# EAGLE board Resistor_Resistor (EAGLE 8.3.0), part 20 of 32
## Placement (x,y rotation side) (continued)
R24234  10K  [0201]  172.87,21.39 0 top
R24235  10K  [0201]  172.87,22 0 top
R24236  10K  [0201]  172.87,22.61 0 top
R24237  10K  [0201]  172.87,23.22 0 top
R24238  10K  [0201]  172.87,23.83 0 top
R24239  10K  [0201]  172.87,24.43 0 top
R24240  10K  [0201]  172.87,25.04 0 top
R24241  10K  [0201]  172.87,25.65 0 top
R24242  10K  [0201]  172.87,26.26 0 top
R24243  10K  [0201]  172.87,26.87 0 top
R24244  10K  [0201]  172.87,27.48 0 top
R24245  10K  [0201]  172.87,28.09 0 top
R24246  10K  [0201]  172.87,28.7 0 top
R24247  10K  [0201]  172.87,29.31 0 top
R24248  10K  [0201]  172.87,29.92 0 top
R24249  10K  [0201]  172.87,30.53 0 top
R24250  10K  [0201]  172.87,31.14 0 top
R24251  10K  [0201]  172.87,31.75 0 top
R24252  10K  [0201]  172.87,32.36 0 top
R24253  10K  [0201]  172.87,32.97 0 top
R24254  10K  [0201]  172.87,33.58 0 top
R24255  10K  [0201]  172.87,34.19 0 top
R24256  10K  [0201]  172.87,34.8 0 top
R24257  10K  [0201]  172.87,35.41 0 top
R24258  10K  [0201]  172.87,36.02 0 top
R24259  10K  [0201]  172.87,36.63 0 top
R24260  10K  [0201]  172.87,37.24 0 top
R24261  10K  [0201]  172.87,37.85 0 top
R24262  10K  [0201]  172.87,38.46 0 top
R24263  10K  [0201]  172.87,39.07 0 top
R24264  10K  [0201]  172.87,39.67 0 top
R24265  10K  [0201]  172.87,40.28 0 top
R24266  10K  [0201]  172.87,40.89 0 top
R24267  10K  [0201]  172.87,41.5 0 top
R24268  10K  [0201]  172.87,42.11 0 top
R24269  10K  [0201]  172.87,42.72 0 top
R24270  10K  [0201]  172.87,43.33 0 top
R24271  10K  [0201]  172.87,43.94 0 top
R24272  10K  [0201]  172.87,44.55 0 top
R24273  10K  [0201]  172.87,45.16 0 top
R24274  10K  [0201]  172.87,45.77 0 top
R24275  10K  [0201]  172.87,46.38 0 top
R24276  10K  [0201]  172.87,46.99 0 top
R24277  10K  [0201]  172.87,47.6 0 top
R24278  10K  [0201]  172.87,48.21 0 top
R24279  10K  [0201]  172.87,48.82 0 top
R24280  10K  [0201]  172.87,49.43 0 top
R24281  10K  [0201]  172.87,50.04 0 top
R24282  10K  [0201]  172.87,50.65 0 top
R24283  10K  [0201]  172.87,51.26 0 top
R24284  10K  [0201]  172.87,51.87 0 top
R24285  10K  [0201]  172.87,52.48 0 top
R24286  10K  [0201]  172.87,53.09 0 top
R24287  10K  [0201]  172.87,53.7 0 top
R24288  10K  [0201]  172.87,54.31 0 top
R24289  10K  [0201]  172.87,54.91 0 top
R24290  10K  [0201]  172.87,55.52 0 top
R24291  10K  [0201]  172.87,56.13 0 top
R24292  10K  [0201]  172.87,56.74 0 top
R24293  10K  [0201]  172.87,57.35 0 top
R24294  10K  [0201]  172.87,57.96 0 top
R24295  10K  [0201]  172.87,58.57 0 top
R24296  10K  [0201]  172.87,59.18 0 top
R24297  10K  [0201]  172.87,59.79 0 top
R24298  10K  [0201]  172.87,60.4 0 top
R24299  10K  [0201]  172.87,61.01 0 top
R24300  10K  [0201]  172.87,61.62 0 top
R24301  10K  [0201]  172.87,62.23 0 top
R24302  10K  [0201]  172.87,62.84 0 top
R24303  10K  [0201]  172.87,63.45 0 top
R24304  10K  [0201]  172.87,64.06 0 top
R24305  10K  [0201]  172.87,64.67 0 top
R24306  10K  [0201]  172.87,65.28 0 top
R24307  10K  [0201]  172.87,65.89 0 top
R24308  10K  [0201]  172.87,66.5 0 top
R24309  10K  [0201]  172.87,67.11 0 top
R24310  10K  [0201]  172.87,67.72 0 top
R24311  10K  [0201]  172.87,68.33 0 top
R24312  10K  [0201]  172.87,68.94 0 top
R24313  10K  [0201]  172.87,69.55 0 top
R24314  10K  [0201]  172.87,70.15 0 top
R24315  10K  [0201]  172.87,70.76 0 top
R24316  10K  [0201]  172.87,71.37 0 top
R24317  10K  [0201]  172.87,71.98 0 top
R24318  10K  [0201]  172.87,72.59 0 top
R24319  10K  [0201]  172.87,73.2 0 top
R24320  10K  [0201]  172.87,73.81 0 top
R24321  10K  [0201]  172.87,74.42 0 top
R24322  10K  [0201]  172.87,75.03 0 top
R24323  10K  [0201]  172.87,75.64 0 top
R24324  10K  [0201]  172.87,76.25 0 top
R24325  10K  [0201]  172.87,76.86 0 top
R24326  10K  [0201]  172.87,77.47 0 top
R24327  10K  [0201]  172.87,78.08 0 top
R24328  10K  [0201]  172.87,78.69 0 top
R24329  10K  [0201]  172.87,79.3 0 top
R24330  10K  [0201]  172.87,79.91 0 top
R24331  10K  [0201]  172.87,80.52 0 top
R24332  10K  [0201]  172.87,81.13 0 top
R24333  10K  [0201]  172.87,81.74 0 top
R24334  10K  [0201]  172.87,82.35 0 top
R24335  10K  [0201]  172.87,82.96 0 top
R24336  10K  [0201]  172.87,83.57 0 top
R24337  10K  [0201]  172.87,84.18 0 top
R24338  10K  [0201]  172.87,84.79 0 top
R24339  10K  [0201]  172.87,85.39 0 top
R24340  10K  [0201]  172.87,86 0 top
R24341  10K  [0201]  172.87,86.61 0 top
R24342  10K  [0201]  172.87,87.22 0 top
R24343  10K  [0201]  172.87,87.83 0 top
R24344  10K  [0201]  172.87,88.44 0 top
R24345  10K  [0201]  172.87,89.05 0 top
R24346  10K  [0201]  172.87,89.66 0 top
R24347  10K  [0201]  172.87,90.27 0 top
R24348  10K  [0201]  172.87,90.88 0 top
R24349  10K  [0201]  172.87,91.49 0 top
R24350  10K  [0201]  172.87,92.1 0 top
R24351  10K  [0201]  172.87,92.71 0 top
R24352  10K  [0201]  172.87,93.32 0 top
R24353  10K  [0201]  172.87,93.93 0 top
R24354  10K  [0201]  172.87,94.54 0 top
R24355  10K  [0201]  172.87,95.15 0 top
R24356  10K  [0201]  172.87,95.76 0 top
R24357  10K  [0201]  172.87,96.37 0 top
R24358  10K  [0201]  172.87,96.98 0 top
R24359  10K  [0201]  172.87,97.59 0 top
R24360  10K  [0201]  172.87,98.2 0 top
R24361  10K  [0201]  172.87,98.81 0 top
R24362  10K  [0201]  172.87,99.42 0 top
R24363  10K  [0201]  172.87,100.03 0 top
R24364  10K  [0201]  172.87,100.63 0 top
R24365  10K  [0201]  172.87,101.24 0 top
R24366  10K  [0201]  172.87,101.85 0 top
R24367  10K  [0201]  172.87,102.46 0 top
R24368  10K  [0201]  172.87,103.07 0 top
R24369  10K  [0201]  172.87,103.68 0 top
R24370  10K  [0201]  172.87,104.29 0 top
R24371  10K  [0201]  172.87,104.9 0 top
R24372  10K  [0201]  172.87,105.51 0 top
R24373  10K  [0201]  172.87,106.12 0 top
R24374  10K  [0201]  172.87,106.73 0 top
R24375  10K  [0201]  172.87,107.34 0 top
R24376  10K  [0201]  172.87,107.95 0 top
R24377  10K  [0201]  172.87,108.56 0 top
R24378  10K  [0201]  172.87,109.17 0 top
R24379  10K  [0201]  172.87,109.78 0 top
R24380  10K  [0201]  172.87,110.39 0 top
R24381  10K  [0201]  172.87,111 0 top
R24382  10K  [0201]  172.87,111.61 0 top
R24383  10K  [0201]  172.87,112.22 0 top
R24384  10K  [0201]  172.87,112.83 0 top
R24385  10K  [0201]  172.87,113.44 0 top
R24386  10K  [0201]  172.87,114.05 0 top
R24387  10K  [0201]  172.87,114.66 0 top
R24388  10K  [0201]  172.87,115.27 0 top
R24389  10K  [0201]  172.87,115.87 0 top
R24390  10K  [0201]  172.87,116.48 0 top
R24391  10K  [0201]  172.87,117.09 0 top
R24392  10K  [0201]  172.87,117.7 0 top
R24393  10K  [0201]  172.87,118.31 0 top
R24394  10K  [0201]  172.87,118.92 0 top
R24395  10K  [0201]  172.87,119.53 0 top
R24396  10K  [0201]  172.87,120.14 0 top
R24397  10K  [0201]  172.87,120.75 0 top
R24398  10K  [0201]  172.87,121.36 0 top
R24399  10K  [0201]  172.87,121.97 0 top
R24400  10K  [0201]  172.87,122.58 0 top
R24401  10K  [0201]  174.09,1.27 0 top
R24402  10K  [0201]  174.09,1.88 0 top
R24403  10K  [0201]  174.09,2.49 0 top
R24404  10K  [0201]  174.09,3.1 0 top
R24405  10K  [0201]  174.09,3.71 0 top
R24406  10K  [0201]  174.09,4.32 0 top
R24407  10K  [0201]  174.09,4.93 0 top
R24408  10K  [0201]  174.09,5.54 0 top
R24409  10K  [0201]  174.09,6.15 0 top
R24410  10K  [0201]  174.09,6.76 0 top
R24411  10K  [0201]  174.09,7.37 0 top
R24412  10K  [0201]  174.09,7.98 0 top
R24413  10K  [0201]  174.09,8.59 0 top
R24414  10K  [0201]  174.09,9.19 0 top
R24415  10K  [0201]  174.09,9.8 0 top
R24416  10K  [0201]  174.09,10.41 0 top
R24417  10K  [0201]  174.09,11.02 0 top
R24418  10K  [0201]  174.09,11.63 0 top
R24419  10K  [0201]  174.09,12.24 0 top
R24420  10K  [0201]  174.09,12.85 0 top
R24421  10K  [0201]  174.09,13.46 0 top
R24422  10K  [0201]  174.09,14.07 0 top
R24423  10K  [0201]  174.09,14.68 0 top
R24424  10K  [0201]  174.09,15.29 0 top
R24425  10K  [0201]  174.09,15.9 0 top
R24426  10K  [0201]  174.09,16.51 0 top
R24427  10K  [0201]  174.09,17.12 0 top
R24428  10K  [0201]  174.09,17.73 0 top
R24429  10K  [0201]  174.09,18.34 0 top
R24430  10K  [0201]  174.09,18.95 0 top
R24431  10K  [0201]  174.09,19.56 0 top
R24432  10K  [0201]  174.09,20.17 0 top
R24433  10K  [0201]  174.09,20.78 0 top
R24434  10K  [0201]  174.09,21.39 0 top
R24435  10K  [0201]  174.09,22 0 top
R24436  10K  [0201]  174.09,22.61 0 top
R24437  10K  [0201]  174.09,23.22 0 top
R24438  10K  [0201]  174.09,23.83 0 top
R24439  10K  [0201]  174.09,24.43 0 top
R24440  10K  [0201]  174.09,25.04 0 top
R24441  10K  [0201]  174.09,25.65 0 top
R24442  10K  [0201]  174.09,26.26 0 top
R24443  10K  [0201]  174.09,26.87 0 top
R24444  10K  [0201]  174.09,27.48 0 top
R24445  10K  [0201]  174.09,28.09 0 top
R24446  10K  [0201]  174.09,28.7 0 top
R24447  10K  [0201]  174.09,29.31 0 top
R24448  10K  [0201]  174.09,29.92 0 top
R24449  10K  [0201]  174.09,30.53 0 top
R24450  10K  [0201]  174.09,31.14 0 top
R24451  10K  [0201]  174.09,31.75 0 top
R24452  10K  [0201]  174.09,32.36 0 top
R24453  10K  [0201]  174.09,32.97 0 top
R24454  10K  [0201]  174.09,33.58 0 top
R24455  10K  [0201]  174.09,34.19 0 top
R24456  10K  [0201]  174.09,34.8 0 top
R24457  10K  [0201]  174.09,35.41 0 top
R24458  10K  [0201]  174.09,36.02 0 top
R24459  10K  [0201]  174.09,36.63 0 top
R24460  10K  [0201]  174.09,37.24 0 top
R24461  10K  [0201]  174.09,37.85 0 top
R24462  10K  [0201]  174.09,38.46 0 top
R24463  10K  [0201]  174.09,39.07 0 top
R24464  10K  [0201]  174.09,39.67 0 top
R24465  10K  [0201]  174.09,40.28 0 top
R24466  10K  [0201]  174.09,40.89 0 top
R24467  10K  [0201]  174.09,41.5 0 top
R24468  10K  [0201]  174.09,42.11 0 top
R24469  10K  [0201]  174.09,42.72 0 top
R24470  10K  [0201]  174.09,43.33 0 top
R24471  10K  [0201]  174.09,43.94 0 top
R24472  10K  [0201]  174.09,44.55 0 top
R24473  10K  [0201]  174.09,45.16 0 top
R24474  10K  [0201]  174.09,45.77 0 top
R24475  10K  [0201]  174.09,46.38 0 top
R24476  10K  [0201]  174.09,46.99 0 top
R24477  10K  [0201]  174.09,47.6 0 top
R24478  10K  [0201]  174.09,48.21 0 top
R24479  10K  [0201]  174.09,48.82 0 top
R24480  10K  [0201]  174.09,49.43 0 top
R24481  10K  [0201]  174.09,50.04 0 top
R24482  10K  [0201]  174.09,50.65 0 top
R24483  10K  [0201]  174.09,51.26 0 top
R24484  10K  [0201]  174.09,51.87 0 top
R24485  10K  [0201]  174.09,52.48 0 top
R24486  10K  [0201]  174.09,53.09 0 top
R24487  10K  [0201]  174.09,53.7 0 top
R24488  10K  [0201]  174.09,54.31 0 top
R24489  10K  [0201]  174.09,54.91 0 top
R24490  10K  [0201]  174.09,55.52 0 top
R24491  10K  [0201]  174.09,56.13 0 top
R24492  10K  [0201]  174.09,56.74 0 top
R24493  10K  [0201]  174.09,57.35 0 top
R24494  10K  [0201]  174.09,57.96 0 top
R24495  10K  [0201]  174.09,58.57 0 top
R24496  10K  [0201]  174.09,59.18 0 top
R24497  10K  [0201]  174.09,59.79 0 top
R24498  10K  [0201]  174.09,60.4 0 top
R24499  10K  [0201]  174.09,61.01 0 top
R24500  10K  [0201]  174.09,61.62 0 top
R24501  10K  [0201]  174.09,62.23 0 top
R24502  10K  [0201]  174.09,62.84 0 top
R24503  10K  [0201]  174.09,63.45 0 top
R24504  10K  [0201]  174.09,64.06 0 top
R24505  10K  [0201]  174.09,64.67 0 top
R24506  10K  [0201]  174.09,65.28 0 top
R24507  10K  [0201]  174.09,65.89 0 top
R24508  10K  [0201]  174.09,66.5 0 top
R24509  10K  [0201]  174.09,67.11 0 top
R24510  10K  [0201]  174.09,67.72 0 top
R24511  10K  [0201]  174.09,68.33 0 top
R24512  10K  [0201]  174.09,68.94 0 top
R24513  10K  [0201]  174.09,69.55 0 top
R24514  10K  [0201]  174.09,70.15 0 top
R24515  10K  [0201]  174.09,70.76 0 top
R24516  10K  [0201]  174.09,71.37 0 top
R24517  10K  [0201]  174.09,71.98 0 top
R24518  10K  [0201]  174.09,72.59 0 top
R24519  10K  [0201]  174.09,73.2 0 top
R24520  10K  [0201]  174.09,73.81 0 top
R24521  10K  [0201]  174.09,74.42 0 top
R24522  10K  [0201]  174.09,75.03 0 top
R24523  10K  [0201]  174.09,75.64 0 top
R24524  10K  [0201]  174.09,76.25 0 top
R24525  10K  [0201]  174.09,76.86 0 top
R24526  10K  [0201]  174.09,77.47 0 top
R24527  10K  [0201]  174.09,78.08 0 top
R24528  10K  [0201]  174.09,78.69 0 top
R24529  10K  [0201]  174.09,79.3 0 top
R24530  10K  [0201]  174.09,79.91 0 top
R24531  10K  [0201]  174.09,80.52 0 top
R24532  10K  [0201]  174.09,81.13 0 top
R24533  10K  [0201]  174.09,81.74 0 top
R24534  10K  [0201]  174.09,82.35 0 top
R24535  10K  [0201]  174.09,82.96 0 top
R24536  10K  [0201]  174.09,83.57 0 top
R24537  10K  [0201]  174.09,84.18 0 top
R24538  10K  [0201]  174.09,84.79 0 top
R24539  10K  [0201]  174.09,85.39 0 top
R24540  10K  [0201]  174.09,86 0 top
R24541  10K  [0201]  174.09,86.61 0 top
R24542  10K  [0201]  174.09,87.22 0 top
R24543  10K  [0201]  174.09,87.83 0 top
R24544  10K  [0201]  174.09,88.44 0 top
R24545  10K  [0201]  174.09,89.05 0 top
R24546  10K  [0201]  174.09,89.66 0 top
R24547  10K  [0201]  174.09,90.27 0 top
R24548  10K  [0201]  174.09,90.88 0 top
R24549  10K  [0201]  174.09,91.49 0 top
R24550  10K  [0201]  174.09,92.1 0 top
R24551  10K  [0201]  174.09,92.71 0 top
R24552  10K  [0201]  174.09,93.32 0 top
R24553  10K  [0201]  174.09,93.93 0 top
R24554  10K  [0201]  174.09,94.54 0 top
R24555  10K  [0201]  174.09,95.15 0 top
R24556  10K  [0201]  174.09,95.76 0 top
R24557  10K  [0201]  174.09,96.37 0 top
R24558  10K  [0201]  174.09,96.98 0 top
R24559  10K  [0201]  174.09,97.59 0 top
R24560  10K  [0201]  174.09,98.2 0 top
R24561  10K  [0201]  174.09,98.81 0 top
R24562  10K  [0201]  174.09,99.42 0 top
R24563  10K  [0201]  174.09,100.03 0 top
R24564  10K  [0201]  174.09,100.63 0 top
R24565  10K  [0201]  174.09,101.24 0 top
R24566  10K  [0201]  174.09,101.85 0 top
R24567  10K  [0201]  174.09,102.46 0 top
R24568  10K  [0201]  174.09,103.07 0 top
R24569  10K  [0201]  174.09,103.68 0 top
R24570  10K  [0201]  174.09,104.29 0 top
R24571  10K  [0201]  174.09,104.9 0 top
R24572  10K  [0201]  174.09,105.51 0 top
R24573  10K  [0201]  174.09,106.12 0 top
R24574  10K  [0201]  174.09,106.73 0 top
R24575  10K  [0201]  174.09,107.34 0 top
R24576  10K  [0201]  174.09,107.95 0 top
R24577  10K  [0201]  174.09,108.56 0 top
R24578  10K  [0201]  174.09,109.17 0 top
R24579  10K  [0201]  174.09,109.78 0 top
R24580  10K  [0201]  174.09,110.39 0 top
R24581  10K  [0201]  174.09,111 0 top
R24582  10K  [0201]  174.09,111.61 0 top
R24583  10K  [0201]  174.09,112.22 0 top
R24584  10K  [0201]  174.09,112.83 0 top
R24585  10K  [0201]  174.09,113.44 0 top
R24586  10K  [0201]  174.09,114.05 0 top
R24587  10K  [0201]  174.09,114.66 0 top
R24588  10K  [0201]  174.09,115.27 0 top
R24589  10K  [0201]  174.09,115.87 0 top
R24590  10K  [0201]  174.09,116.48 0 top
R24591  10K  [0201]  174.09,117.09 0 top
R24592  10K  [0201]  174.09,117.7 0 top
R24593  10K  [0201]  174.09,118.31 0 top
R24594  10K  [0201]  174.09,118.92 0 top
R24595  10K  [0201]  174.09,119.53 0 top
R24596  10K  [0201]  174.09,120.14 0 top
R24597  10K  [0201]  174.09,120.75 0 top
R24598  10K  [0201]  174.09,121.36 0 top
R24599  10K  [0201]  174.09,121.97 0 top
R24600  10K  [0201]  174.09,122.58 0 top
R24601  10K  [0201]  175.31,1.27 0 top
R24602  10K  [0201]  175.31,1.88 0 top
R24603  10K  [0201]  175.31,2.49 0 top
R24604  10K  [0201]  175.31,3.1 0 top
R24605  10K  [0201]  175.31,3.71 0 top
R24606  10K  [0201]  175.31,4.32 0 top
R24607  10K  [0201]  175.31,4.93 0 top
R24608  10K  [0201]  175.31,5.54 0 top
R24609  10K  [0201]  175.31,6.15 0 top
R24610  10K  [0201]  175.31,6.76 0 top
R24611  10K  [0201]  175.31,7.37 0 top
R24612  10K  [0201]  175.31,7.98 0 top
R24613  10K  [0201]  175.31,8.59 0 top
R24614  10K  [0201]  175.31,9.19 0 top
R24615  10K  [0201]  175.31,9.8 0 top
R24616  10K  [0201]  175.31,10.41 0 top
R24617  10K  [0201]  175.31,11.02 0 top
R24618  10K  [0201]  175.31,11.63 0 top
R24619  10K  [0201]  175.31,12.24 0 top
R24620  10K  [0201]  175.31,12.85 0 top
R24621  10K  [0201]  175.31,13.46 0 top
R24622  10K  [0201]  175.31,14.07 0 top
R24623  10K  [0201]  175.31,14.68 0 top
R24624  10K  [0201]  175.31,15.29 0 top
R24625  10K  [0201]  175.31,15.9 0 top
R24626  10K  [0201]  175.31,16.51 0 top
R24627  10K  [0201]  175.31,17.12 0 top
R24628  10K  [0201]  175.31,17.73 0 top
R24629  10K  [0201]  175.31,18.34 0 top
R24630  10K  [0201]  175.31,18.95 0 top
R24631  10K  [0201]  175.31,19.56 0 top
R24632  10K  [0201]  175.31,20.17 0 top
R24633  10K  [0201]  175.31,20.78 0 top
R24634  10K  [0201]  175.31,21.39 0 top
R24635  10K  [0201]  175.31,22 0 top
R24636  10K  [0201]  175.31,22.61 0 top
R24637  10K  [0201]  175.31,23.22 0 top
R24638  10K  [0201]  175.31,23.83 0 top
R24639  10K  [0201]  175.31,24.43 0 top
R24640  10K  [0201]  175.31,25.04 0 top
R24641  10K  [0201]  175.31,25.65 0 top
R24642  10K  [0201]  175.31,26.26 0 top
R24643  10K  [0201]  175.31,26.87 0 top
R24644  10K  [0201]  175.31,27.48 0 top
R24645  10K  [0201]  175.31,28.09 0 top
R24646  10K  [0201]  175.31,28.7 0 top
R24647  10K  [0201]  175.31,29.31 0 top
R24648  10K  [0201]  175.31,29.92 0 top
R24649  10K  [0201]  175.31,30.53 0 top
R24650  10K  [0201]  175.31,31.14 0 top
R24651  10K  [0201]  175.31,31.75 0 top
R24652  10K  [0201]  175.31,32.36 0 top
R24653  10K  [0201]  175.31,32.97 0 top
R24654  10K  [0201]  175.31,33.58 0 top
R24655  10K  [0201]  175.31,34.19 0 top
R24656  10K  [0201]  175.31,34.8 0 top
R24657  10K  [0201]  175.31,35.41 0 top
R24658  10K  [0201]  175.31,36.02 0 top
R24659  10K  [0201]  175.31,36.63 0 top
R24660  10K  [0201]  175.31,37.24 0 top
R24661  10K  [0201]  175.31,37.85 0 top
R24662  10K  [0201]  175.31,38.46 0 top
R24663  10K  [0201]  175.31,39.07 0 top
R24664  10K  [0201]  175.31,39.67 0 top
R24665  10K  [0201]  175.31,40.28 0 top
R24666  10K  [0201]  175.31,40.89 0 top
R24667  10K  [0201]  175.31,41.5 0 top
R24668  10K  [0201]  175.31,42.11 0 top
R24669  10K  [0201]  175.31,42.72 0 top
R24670  10K  [0201]  175.31,43.33 0 top
R24671  10K  [0201]  175.31,43.94 0 top
R24672  10K  [0201]  175.31,44.55 0 top
R24673  10K  [0201]  175.31,45.16 0 top
R24674  10K  [0201]  175.31,45.77 0 top
R24675  10K  [0201]  175.31,46.38 0 top
R24676  10K  [0201]  175.31,46.99 0 top
R24677  10K  [0201]  175.31,47.6 0 top
R24678  10K  [0201]  175.31,48.21 0 top
R24679  10K  [0201]  175.31,48.82 0 top
R24680  10K  [0201]  175.31,49.43 0 top
R24681  10K  [0201]  175.31,50.04 0 top
R24682  10K  [0201]  175.31,50.65 0 top
R24683  10K  [0201]  175.31,51.26 0 top
R24684  10K  [0201]  175.31,51.87 0 top
R24685  10K  [0201]  175.31,52.48 0 top
R24686  10K  [0201]  175.31,53.09 0 top
R24687  10K  [0201]  175.31,53.7 0 top
R24688  10K  [0201]  175.31,54.31 0 top
R24689  10K  [0201]  175.31,54.91 0 top
R24690  10K  [0201]  175.31,55.52 0 top
R24691  10K  [0201]  175.31,56.13 0 top
R24692  10K  [0201]  175.31,56.74 0 top
R24693  10K  [0201]  175.31,57.35 0 top
R24694  10K  [0201]  175.31,57.96 0 top
R24695  10K  [0201]  175.31,58.57 0 top
R24696  10K  [0201]  175.31,59.18 0 top
R24697  10K  [0201]  175.31,59.79 0 top
R24698  10K  [0201]  175.31,60.4 0 top
R24699  10K  [0201]  175.31,61.01 0 top
R24700  10K  [0201]  175.31,61.62 0 top
R24701  10K  [0201]  175.31,62.23 0 top
R24702  10K  [0201]  175.31,62.84 0 top
R24703  10K  [0201]  175.31,63.45 0 top
R24704  10K  [0201]  175.31,64.06 0 top
R24705  10K  [0201]  175.31,64.67 0 top
R24706  10K  [0201]  175.31,65.28 0 top
R24707  10K  [0201]  175.31,65.89 0 top
R24708  10K  [0201]  175.31,66.5 0 top
R24709  10K  [0201]  175.31,67.11 0 top
R24710  10K  [0201]  175.31,67.72 0 top
R24711  10K  [0201]  175.31,68.33 0 top
R24712  10K  [0201]  175.31,68.94 0 top
R24713  10K  [0201]  175.31,69.55 0 top
R24714  10K  [0201]  175.31,70.15 0 top
R24715  10K  [0201]  175.31,70.76 0 top
R24716  10K  [0201]  175.31,71.37 0 top
R24717  10K  [0201]  175.31,71.98 0 top
R24718  10K  [0201]  175.31,72.59 0 top
R24719  10K  [0201]  175.31,73.2 0 top
R24720  10K  [0201]  175.31,73.81 0 top
R24721  10K  [0201]  175.31,74.42 0 top
R24722  10K  [0201]  175.31,75.03 0 top
R24723  10K  [0201]  175.31,75.64 0 top
R24724  10K  [0201]  175.31,76.25 0 top
R24725  10K  [0201]  175.31,76.86 0 top
R24726  10K  [0201]  175.31,77.47 0 top
R24727  10K  [0201]  175.31,78.08 0 top
R24728  10K  [0201]  175.31,78.69 0 top
R24729  10K  [0201]  175.31,79.3 0 top
R24730  10K  [0201]  175.31,79.91 0 top
R24731  10K  [0201]  175.31,80.52 0 top
R24732  10K  [0201]  175.31,81.13 0 top
R24733  10K  [0201]  175.31,81.74 0 top
R24734  10K  [0201]  175.31,82.35 0 top
R24735  10K  [0201]  175.31,82.96 0 top
R24736  10K  [0201]  175.31,83.57 0 top
R24737  10K  [0201]  175.31,84.18 0 top
R24738  10K  [0201]  175.31,84.79 0 top
R24739  10K  [0201]  175.31,85.39 0 top
R24740  10K  [0201]  175.31,86 0 top
R24741  10K  [0201]  175.31,86.61 0 top
R24742  10K  [0201]  175.31,87.22 0 top
R24743  10K  [0201]  175.31,87.83 0 top
R24744  10K  [0201]  175.31,88.44 0 top
R24745  10K  [0201]  175.31,89.05 0 top
R24746  10K  [0201]  175.31,89.66 0 top
R24747  10K  [0201]  175.31,90.27 0 top
R24748  10K  [0201]  175.31,90.88 0 top
R24749  10K  [0201]  175.31,91.49 0 top
R24750  10K  [0201]  175.31,92.1 0 top
R24751  10K  [0201]  175.31,92.71 0 top
R24752  10K  [0201]  175.31,93.32 0 top
R24753  10K  [0201]  175.31,93.93 0 top
R24754  10K  [0201]  175.31,94.54 0 top
R24755  10K  [0201]  175.31,95.15 0 top
R24756  10K  [0201]  175.31,95.76 0 top
R24757  10K  [0201]  175.31,96.37 0 top
R24758  10K  [0201]  175.31,96.98 0 top
R24759  10K  [0201]  175.31,97.59 0 top
R24760  10K  [0201]  175.31,98.2 0 top
R24761  10K  [0201]  175.31,98.81 0 top
R24762  10K  [0201]  175.31,99.42 0 top
R24763  10K  [0201]  175.31,100.03 0 top
R24764  10K  [0201]  175.31,100.63 0 top
R24765  10K  [0201]  175.31,101.24 0 top
R24766  10K  [0201]  175.31,101.85 0 top
R24767  10K  [0201]  175.31,102.46 0 top
R24768  10K  [0201]  175.31,103.07 0 top
R24769  10K  [0201]  175.31,103.68 0 top
R24770  10K  [0201]  175.31,104.29 0 top
R24771  10K  [0201]  175.31,104.9 0 top
R24772  10K  [0201]  175.31,105.51 0 top
R24773  10K  [0201]  175.31,106.12 0 top
R24774  10K  [0201]  175.31,106.73 0 top
R24775  10K  [0201]  175.31,107.34 0 top
R24776  10K  [0201]  175.31,107.95 0 top
R24777  10K  [0201]  175.31,108.56 0 top
R24778  10K  [0201]  175.31,109.17 0 top
R24779  10K  [0201]  175.31,109.78 0 top
R24780  10K  [0201]  175.31,110.39 0 top
R24781  10K  [0201]  175.31,111 0 top
R24782  10K  [0201]  175.31,111.61 0 top
R24783  10K  [0201]  175.31,112.22 0 top
R24784  10K  [0201]  175.31,112.83 0 top
R24785  10K  [0201]  175.31,113.44 0 top
R24786  10K  [0201]  175.31,114.05 0 top
R24787  10K  [0201]  175.31,114.66 0 top
R24788  10K  [0201]  175.31,115.27 0 top
R24789  10K  [0201]  175.31,115.87 0 top
R24790  10K  [0201]  175.31,116.48 0 top
R24791  10K  [0201]  175.31,117.09 0 top
R24792  10K  [0201]  175.31,117.7 0 top
R24793  10K  [0201]  175.31,118.31 0 top
R24794  10K  [0201]  175.31,118.92 0 top
R24795  10K  [0201]  175.31,119.53 0 top
R24796  10K  [0201]  175.31,120.14 0 top
R24797  10K  [0201]  175.31,120.75 0 top
R24798  10K  [0201]  175.31,121.36 0 top
R24799  10K  [0201]  175.31,121.97 0 top
R24800  10K  [0201]  175.31,122.58 0 top
R24801  10K  [0201]  176.53,1.27 0 top
R24802  10K  [0201]  176.53,1.88 0 top
R24803  10K  [0201]  176.53,2.49 0 top
R24804  10K  [0201]  176.53,3.1 0 top
R24805  10K  [0201]  176.53,3.71 0 top
R24806  10K  [0201]  176.53,4.32 0 top
R24807  10K  [0201]  176.53,4.93 0 top
R24808  10K  [0201]  176.53,5.54 0 top
R24809  10K  [0201]  176.53,6.15 0 top
R24810  10K  [0201]  176.53,6.76 0 top
R24811  10K  [0201]  176.53,7.37 0 top
R24812  10K  [0201]  176.53,7.98 0 top
R24813  10K  [0201]  176.53,8.59 0 top
R24814  10K  [0201]  176.53,9.19 0 top
R24815  10K  [0201]  176.53,9.8 0 top
R24816  10K  [0201]  176.53,10.41 0 top
R24817  10K  [0201]  176.53,11.02 0 top
R24818  10K  [0201]  176.53,11.63 0 top
R24819  10K  [0201]  176.53,12.24 0 top
R24820  10K  [0201]  176.53,12.85 0 top
R24821  10K  [0201]  176.53,13.46 0 top
R24822  10K  [0201]  176.53,14.07 0 top
R24823  10K  [0201]  176.53,14.68 0 top
R24824  10K  [0201]  176.53,15.29 0 top
R24825  10K  [0201]  176.53,15.9 0 top
R24826  10K  [0201]  176.53,16.51 0 top
R24827  10K  [0201]  176.53,17.12 0 top
R24828  10K  [0201]  176.53,17.73 0 top
R24829  10K  [0201]  176.53,18.34 0 top
R24830  10K  [0201]  176.53,18.95 0 top
R24831  10K  [0201]  176.53,19.56 0 top
R24832  10K  [0201]  176.53,20.17 0 top
R24833  10K  [0201]  176.53,20.78 0 top
R24834  10K  [0201]  176.53,21.39 0 top
R24835  10K  [0201]  176.53,22 0 top
R24836  10K  [0201]  176.53,22.61 0 top
R24837  10K  [0201]  176.53,23.22 0 top
R24838  10K  [0201]  176.53,23.83 0 top
R24839  10K  [0201]  176.53,24.43 0 top
R24840  10K  [0201]  176.53,25.04 0 top
R24841  10K  [0201]  176.53,25.65 0 top
R24842  10K  [0201]  176.53,26.26 0 top
R24843  10K  [0201]  176.53,26.87 0 top
R24844  10K  [0201]  176.53,27.48 0 top
R24845  10K  [0201]  176.53,28.09 0 top
R24846  10K  [0201]  176.53,28.7 0 top
R24847  10K  [0201]  176.53,29.31 0 top
R24848  10K  [0201]  176.53,29.92 0 top
R24849  10K  [0201]  176.53,30.53 0 top
R24850  10K  [0201]  176.53,31.14 0 top
R24851  10K  [0201]  176.53,31.75 0 top
R24852  10K  [0201]  176.53,32.36 0 top
R24853  10K  [0201]  176.53,32.97 0 top
R24854  10K  [0201]  176.53,33.58 0 top
R24855  10K  [0201]  176.53,34.19 0 top
R24856  10K  [0201]  176.53,34.8 0 top
R24857  10K  [0201]  176.53,35.41 0 top
R24858  10K  [0201]  176.53,36.02 0 top
R24859  10K  [0201]  176.53,36.63 0 top
R24860  10K  [0201]  176.53,37.24 0 top
R24861  10K  [0201]  176.53,37.85 0 top
R24862  10K  [0201]  176.53,38.46 0 top
R24863  10K  [0201]  176.53,39.07 0 top
R24864  10K  [0201]  176.53,39.67 0 top
R24865  10K  [0201]  176.53,40.28 0 top
R24866  10K  [0201]  176.53,40.89 0 top
R24867  10K  [0201]  176.53,41.5 0 top
R24868  10K  [0201]  176.53,42.11 0 top
R24869  10K  [0201]  176.53,42.72 0 top
R24870  10K  [0201]  176.53,43.33 0 top
R24871  10K  [0201]  176.53,43.94 0 top
R24872  10K  [0201]  176.53,44.55 0 top
R24873  10K  [0201]  176.53,45.16 0 top
R24874  10K  [0201]  176.53,45.77 0 top
R24875  10K  [0201]  176.53,46.38 0 top
R24876  10K  [0201]  176.53,46.99 0 top
R24877  10K  [0201]  176.53,47.6 0 top
R24878  10K  [0201]  176.53,48.21 0 top
R24879  10K  [0201]  176.53,48.82 0 top
R24880  10K  [0201]  176.53,49.43 0 top
R24881  10K  [0201]  176.53,50.04 0 top
R24882  10K  [0201]  176.53,50.65 0 top
R24883  10K  [0201]  176.53,51.26 0 top
R24884  10K  [0201]  176.53,51.87 0 top
R24885  10K  [0201]  176.53,52.48 0 top
R24886  10K  [0201]  176.53,53.09 0 top
R24887  10K  [0201]  176.53,53.7 0 top
R24888  10K  [0201]  176.53,54.31 0 top
R24889  10K  [0201]  176.53,54.91 0 top
R24890  10K  [0201]  176.53,55.52 0 top
R24891  10K  [0201]  176.53,56.13 0 top
R24892  10K  [0201]  176.53,56.74 0 top
R24893  10K  [0201]  176.53,57.35 0 top
R24894  10K  [0201]  176.53,57.96 0 top
R24895  10K  [0201]  176.53,58.57 0 top
R24896  10K  [0201]  176.53,59.18 0 top
R24897  10K  [0201]  176.53,59.79 0 top
R24898  10K  [0201]  176.53,60.4 0 top
R24899  10K  [0201]  176.53,61.01 0 top
R24900  10K  [0201]  176.53,61.62 0 top
R24901  10K  [0201]  176.53,62.23 0 top
R24902  10K  [0201]  176.53,62.84 0 top
R24903  10K  [0201]  176.53,63.45 0 top
R24904  10K  [0201]  176.53,64.06 0 top
R24905  10K  [0201]  176.53,64.67 0 top
R24906  10K  [0201]  176.53,65.28 0 top
R24907  10K  [0201]  176.53,65.89 0 top
R24908  10K  [0201]  176.53,66.5 0 top
R24909  10K  [0201]  176.53,67.11 0 top
R24910  10K  [0201]  176.53,67.72 0 top
R24911  10K  [0201]  176.53,68.33 0 top
R24912  10K  [0201]  176.53,68.94 0 top
R24913  10K  [0201]  176.53,69.55 0 top
R24914  10K  [0201]  176.53,70.15 0 top
R24915  10K  [0201]  176.53,70.76 0 top
R24916  10K  [0201]  176.53,71.37 0 top
R24917  10K  [0201]  176.53,71.98 0 top
R24918  10K  [0201]  176.53,72.59 0 top
R24919  10K  [0201]  176.53,73.2 0 top
R24920  10K  [0201]  176.53,73.81 0 top
R24921  10K  [0201]  176.53,74.42 0 top
R24922  10K  [0201]  176.53,75.03 0 top
R24923  10K  [0201]  176.53,75.64 0 top
R24924  10K  [0201]  176.53,76.25 0 top
R24925  10K  [0201]  176.53,76.86 0 top
R24926  10K  [0201]  176.53,77.47 0 top
R24927  10K  [0201]  176.53,78.08 0 top
R24928  10K  [0201]  176.53,78.69 0 top
R24929  10K  [0201]  176.53,79.3 0 top
R24930  10K  [0201]  176.53,79.91 0 top
R24931  10K  [0201]  176.53,80.52 0 top
R24932  10K  [0201]  176.53,81.13 0 top
R24933  10K  [0201]  176.53,81.74 0 top
R24934  10K  [0201]  176.53,82.35 0 top
R24935  10K  [0201]  176.53,82.96 0 top
R24936  10K  [0201]  176.53,83.57 0 top
R24937  10K  [0201]  176.53,84.18 0 top
R24938  10K  [0201]  176.53,84.79 0 top
R24939  10K  [0201]  176.53,85.39 0 top
R24940  10K  [0201]  176.53,86 0 top
R24941  10K  [0201]  176.53,86.61 0 top
R24942  10K  [0201]  176.53,87.22 0 top
R24943  10K  [0201]  176.53,87.83 0 top
R24944  10K  [0201]  176.53,88.44 0 top
R24945  10K  [0201]  176.53,89.05 0 top
R24946  10K  [0201]  176.53,89.66 0 top
R24947  10K  [0201]  176.53,90.27 0 top
R24948  10K  [0201]  176.53,90.88 0 top
R24949  10K  [0201]  176.53,91.49 0 top
R24950  10K  [0201]  176.53,92.1 0 top
R24951  10K  [0201]  176.53,92.71 0 top
R24952  10K  [0201]  176.53,93.32 0 top
R24953  10K  [0201]  176.53,93.93 0 top
R24954  10K  [0201]  176.53,94.54 0 top
R24955  10K  [0201]  176.53,95.15 0 top
R24956  10K  [0201]  176.53,95.76 0 top
R24957  10K  [0201]  176.53,96.37 0 top
R24958  10K  [0201]  176.53,96.98 0 top
R24959  10K  [0201]  176.53,97.59 0 top
R24960  10K  [0201]  176.53,98.2 0 top
R24961  10K  [0201]  176.53,98.81 0 top
R24962  10K  [0201]  176.53,99.42 0 top
R24963  10K  [0201]  176.53,100.03 0 top
R24964  10K  [0201]  176.53,100.63 0 top
R24965  10K  [0201]  176.53,101.24 0 top
R24966  10K  [0201]  176.53,101.85 0 top
R24967  10K  [0201]  176.53,102.46 0 top
R24968  10K  [0201]  176.53,103.07 0 top
R24969  10K  [0201]  176.53,103.68 0 top
R24970  10K  [0201]  176.53,104.29 0 top
R24971  10K  [0201]  176.53,104.9 0 top
R24972  10K  [0201]  176.53,105.51 0 top
R24973  10K  [0201]  176.53,106.12 0 top
R24974  10K  [0201]  176.53,106.73 0 top
R24975  10K  [0201]  176.53,107.34 0 top
R24976  10K  [0201]  176.53,107.95 0 top
R24977  10K  [0201]  176.53,108.56 0 top
R24978  10K  [0201]  176.53,109.17 0 top
R24979  10K  [0201]  176.53,109.78 0 top
R24980  10K  [0201]  176.53,110.39 0 top
R24981  10K  [0201]  176.53,111 0 top
R24982  10K  [0201]  176.53,111.61 0 top
R24983  10K  [0201]  176.53,112.22 0 top
R24984  10K  [0201]  176.53,112.83 0 top
R24985  10K  [0201]  176.53,113.44 0 top
R24986  10K  [0201]  176.53,114.05 0 top
R24987  10K  [0201]  176.53,114.66 0 top
R24988  10K  [0201]  176.53,115.27 0 top
R24989  10K  [0201]  176.53,115.87 0 top
R24990  10K  [0201]  176.53,116.48 0 top
R24991  10K  [0201]  176.53,117.09 0 top
R24992  10K  [0201]  176.53,117.7 0 top
R24993  10K  [0201]  176.53,118.31 0 top
R24994  10K  [0201]  176.53,118.92 0 top
R24995  10K  [0201]  176.53,119.53 0 top
R24996  10K  [0201]  176.53,120.14 0 top
R24997  10K  [0201]  176.53,120.75 0 top
R24998  10K  [0201]  176.53,121.36 0 top
R24999  10K  [0201]  176.53,121.97 0 top
R25000  10K  [0201]  176.53,122.58 0 top
R25001  10K  [0201]  177.75,1.27 0 top
R25002  10K  [0201]  177.75,1.88 0 top
R25003  10K  [0201]  177.75,2.49 0 top
R25004  10K  [0201]  177.75,3.1 0 top
R25005  10K  [0201]  177.75,3.71 0 top
R25006  10K  [0201]  177.75,4.32 0 top
R25007  10K  [0201]  177.75,4.93 0 top
R25008  10K  [0201]  177.75,5.54 0 top
R25009  10K  [0201]  177.75,6.15 0 top
R25010  10K  [0201]  177.75,6.76 0 top
R25011  10K  [0201]  177.75,7.37 0 top
R25012  10K  [0201]  177.75,7.98 0 top
R25013  10K  [0201]  177.75,8.59 0 top
R25014  10K  [0201]  177.75,9.19 0 top
R25015  10K  [0201]  177.75,9.8 0 top
R25016  10K  [0201]  177.75,10.41 0 top
R25017  10K  [0201]  177.75,11.02 0 top
R25018  10K  [0201]  177.75,11.63 0 top
R25019  10K  [0201]  177.75,12.24 0 top
R25020  10K  [0201]  177.75,12.85 0 top
R25021  10K  [0201]  177.75,13.46 0 top
R25022  10K  [0201]  177.75,14.07 0 top
R25023  10K  [0201]  177.75,14.68 0 top
R25024  10K  [0201]  177.75,15.29 0 top
R25025  10K  [0201]  177.75,15.9 0 top
R25026  10K  [0201]  177.75,16.51 0 top
R25027  10K  [0201]  177.75,17.12 0 top
R25028  10K  [0201]  177.75,17.73 0 top
R25029  10K  [0201]  177.75,18.34 0 top
R25030  10K  [0201]  177.75,18.95 0 top
R25031  10K  [0201]  177.75,19.56 0 top
R25032  10K  [0201]  177.75,20.17 0 top
R25033  10K  [0201]  177.75,20.78 0 top
R25034  10K  [0201]  177.75,21.39 0 top
R25035  10K  [0201]  177.75,22 0 top
R25036  10K  [0201]  177.75,22.61 0 top
R25037  10K  [0201]  177.75,23.22 0 top
R25038  10K  [0201]  177.75,23.83 0 top
R25039  10K  [0201]  177.75,24.43 0 top
R25040  10K  [0201]  177.75,25.04 0 top
R25041  10K  [0201]  177.75,25.65 0 top
R25042  10K  [0201]  177.75,26.26 0 top
R25043  10K  [0201]  177.75,26.87 0 top
R25044  10K  [0201]  177.75,27.48 0 top
R25045  10K  [0201]  177.75,28.09 0 top
R25046  10K  [0201]  177.75,28.7 0 top
R25047  10K  [0201]  177.75,29.31 0 top
R25048  10K  [0201]  177.75,29.92 0 top
R25049  10K  [0201]  177.75,30.53 0 top
R25050  10K  [0201]  177.75,31.14 0 top
R25051  10K  [0201]  177.75,31.75 0 top
R25052  10K  [0201]  177.75,32.36 0 top
R25053  10K  [0201]  177.75,32.97 0 top
R25054  10K  [0201]  177.75,33.58 0 top
R25055  10K  [0201]  177.75,34.19 0 top
R25056  10K  [0201]  177.75,34.8 0 top
R25057  10K  [0201]  177.75,35.41 0 top
R25058  10K  [0201]  177.75,36.02 0 top
R25059  10K  [0201]  177.75,36.63 0 top
R25060  10K  [0201]  177.75,37.24 0 top
R25061  10K  [0201]  177.75,37.85 0 top
R25062  10K  [0201]  177.75,38.46 0 top
R25063  10K  [0201]  177.75,39.07 0 top
R25064  10K  [0201]  177.75,39.67 0 top
R25065  10K  [0201]  177.75,40.28 0 top
R25066  10K  [0201]  177.75,40.89 0 top
R25067  10K  [0201]  177.75,41.5 0 top
R25068  10K  [0201]  177.75,42.11 0 top
R25069  10K  [0201]  177.75,42.72 0 top
R25070  10K  [0201]  177.75,43.33 0 top
R25071  10K  [0201]  177.75,43.94 0 top
R25072  10K  [0201]  177.75,44.55 0 top
R25073  10K  [0201]  177.75,45.16 0 top
R25074  10K  [0201]  177.75,45.77 0 top
R25075  10K  [0201]  177.75,46.38 0 top
R25076  10K  [0201]  177.75,46.99 0 top
R25077  10K  [0201]  177.75,47.6 0 top
R25078  10K  [0201]  177.75,48.21 0 top
R25079  10K  [0201]  177.75,48.82 0 top
R25080  10K  [0201]  177.75,49.43 0 top
R25081  10K  [0201]  177.75,50.04 0 top
R25082  10K  [0201]  177.75,50.65 0 top
R25083  10K  [0201]  177.75,51.26 0 top
R25084  10K  [0201]  177.75,51.87 0 top
R25085  10K  [0201]  177.75,52.48 0 top
R25086  10K  [0201]  177.75,53.09 0 top
R25087  10K  [0201]  177.75,53.7 0 top
R25088  10K  [0201]  177.75,54.31 0 top
R25089  10K  [0201]  177.75,54.91 0 top
R25090  10K  [0201]  177.75,55.52 0 top
R25091  10K  [0201]  177.75,56.13 0 top
R25092  10K  [0201]  177.75,56.74 0 top
R25093  10K  [0201]  177.75,57.35 0 top
R25094  10K  [0201]  177.75,57.96 0 top
R25095  10K  [0201]  177.75,58.57 0 top
R25096  10K  [0201]  177.75,59.18 0 top
R25097  10K  [0201]  177.75,59.79 0 top
R25098  10K  [0201]  177.75,60.4 0 top
R25099  10K  [0201]  177.75,61.01 0 top
R25100  10K  [0201]  177.75,61.62 0 top
R25101  10K  [0201]  177.75,62.23 0 top
R25102  10K  [0201]  177.75,62.84 0 top
R25103  10K  [0201]  177.75,63.45 0 top
R25104  10K  [0201]  177.75,64.06 0 top
R25105  10K  [0201]  177.75,64.67 0 top
R25106  10K  [0201]  177.75,65.28 0 top
R25107  10K  [0201]  177.75,65.89 0 top
R25108  10K  [0201]  177.75,66.5 0 top
R25109  10K  [0201]  177.75,67.11 0 top
R25110  10K  [0201]  177.75,67.72 0 top
R25111  10K  [0201]  177.75,68.33 0 top
R25112  10K  [0201]  177.75,68.94 0 top
R25113  10K  [0201]  177.75,69.55 0 top
R25114  10K  [0201]  177.75,70.15 0 top
R25115  10K  [0201]  177.75,70.76 0 top
R25116  10K  [0201]  177.75,71.37 0 top
R25117  10K  [0201]  177.75,71.98 0 top
R25118  10K  [0201]  177.75,72.59 0 top
R25119  10K  [0201]  177.75,73.2 0 top
R25120  10K  [0201]  177.75,73.81 0 top
R25121  10K  [0201]  177.75,74.42 0 top
R25122  10K  [0201]  177.75,75.03 0 top
R25123  10K  [0201]  177.75,75.64 0 top
R25124  10K  [0201]  177.75,76.25 0 top
R25125  10K  [0201]  177.75,76.86 0 top
R25126  10K  [0201]  177.75,77.47 0 top
R25127  10K  [0201]  177.75,78.08 0 top
R25128  10K  [0201]  177.75,78.69 0 top
R25129  10K  [0201]  177.75,79.3 0 top
R25130  10K  [0201]  177.75,79.91 0 top
R25131  10K  [0201]  177.75,80.52 0 top
R25132  10K  [0201]  177.75,81.13 0 top
R25133  10K  [0201]  177.75,81.74 0 top
R25134  10K  [0201]  177.75,82.35 0 top
R25135  10K  [0201]  177.75,82.96 0 top
R25136  10K  [0201]  177.75,83.57 0 top
R25137  10K  [0201]  177.75,84.18 0 top
R25138  10K  [0201]  177.75,84.79 0 top
R25139  10K  [0201]  177.75,85.39 0 top
R25140  10K  [0201]  177.75,86 0 top
R25141  10K  [0201]  177.75,86.61 0 top
R25142  10K  [0201]  177.75,87.22 0 top
R25143  10K  [0201]  177.75,87.83 0 top
R25144  10K  [0201]  177.75,88.44 0 top
R25145  10K  [0201]  177.75,89.05 0 top
R25146  10K  [0201]  177.75,89.66 0 top
R25147  10K  [0201]  177.75,90.27 0 top
R25148  10K  [0201]  177.75,90.88 0 top
R25149  10K  [0201]  177.75,91.49 0 top
R25150  10K  [0201]  177.75,92.1 0 top
R25151  10K  [0201]  177.75,92.71 0 top
R25152  10K  [0201]  177.75,93.32 0 top
R25153  10K  [0201]  177.75,93.93 0 top
R25154  10K  [0201]  177.75,94.54 0 top
R25155  10K  [0201]  177.75,95.15 0 top
R25156  10K  [0201]  177.75,95.76 0 top
R25157  10K  [0201]  177.75,96.37 0 top
R25158  10K  [0201]  177.75,96.98 0 top
R25159  10K  [0201]  177.75,97.59 0 top
R25160  10K  [0201]  177.75,98.2 0 top
R25161  10K  [0201]  177.75,98.81 0 top
R25162  10K  [0201]  177.75,99.42 0 top
R25163  10K  [0201]  177.75,100.03 0 top
R25164  10K  [0201]  177.75,100.63 0 top
R25165  10K  [0201]  177.75,101.24 0 top
R25166  10K  [0201]  177.75,101.85 0 top
R25167  10K  [0201]  177.75,102.46 0 top
R25168  10K  [0201]  177.75,103.07 0 top
R25169  10K  [0201]  177.75,103.68 0 top
R25170  10K  [0201]  177.75,104.29 0 top
R25171  10K  [0201]  177.75,104.9 0 top
R25172  10K  [0201]  177.75,105.51 0 top
R25173  10K  [0201]  177.75,106.12 0 top
R25174  10K  [0201]  177.75,106.73 0 top
R25175  10K  [0201]  177.75,107.34 0 top
R25176  10K  [0201]  177.75,107.95 0 top
R25177  10K  [0201]  177.75,108.56 0 top
R25178  10K  [0201]  177.75,109.17 0 top
R25179  10K  [0201]  177.75,109.78 0 top
R25180  10K  [0201]  177.75,110.39 0 top
R25181  10K  [0201]  177.75,111 0 top
R25182  10K  [0201]  177.75,111.61 0 top
R25183  10K  [0201]  177.75,112.22 0 top
R25184  10K  [0201]  177.75,112.83 0 top
R25185  10K  [0201]  177.75,113.44 0 top
R25186  10K  [0201]  177.75,114.05 0 top
R25187  10K  [0201]  177.75,114.66 0 top
R25188  10K  [0201]  177.75,115.27 0 top
R25189  10K  [0201]  177.75,115.87 0 top
R25190  10K  [0201]  177.75,116.48 0 top
R25191  10K  [0201]  177.75,117.09 0 top
R25192  10K  [0201]  177.75,117.7 0 top
R25193  10K  [0201]  177.75,118.31 0 top
R25194  10K  [0201]  177.75,118.92 0 top
R25195  10K  [0201]  177.75,119.53 0 top
R25196  10K  [0201]  177.75,120.14 0 top
R25197  10K  [0201]  177.75,120.75 0 top
R25198  10K  [0201]  177.75,121.36 0 top
R25199  10K  [0201]  177.75,121.97 0 top
R25200  10K  [0201]  177.75,122.58 0 top
R25201  10K  [0201]  178.97,1.27 0 top
R25202  10K  [0201]  178.97,1.88 0 top
R25203  10K  [0201]  178.97,2.49 0 top
R25204  10K  [0201]  178.97,3.1 0 top
R25205  10K  [0201]  178.97,3.71 0 top
R25206  10K  [0201]  178.97,4.32 0 top
R25207  10K  [0201]  178.97,4.93 0 top
R25208  10K  [0201]  178.97,5.54 0 top
R25209  10K  [0201]  178.97,6.15 0 top
R25210  10K  [0201]  178.97,6.76 0 top
R25211  10K  [0201]  178.97,7.37 0 top
R25212  10K  [0201]  178.97,7.98 0 top
R25213  10K  [0201]  178.97,8.59 0 top
R25214  10K  [0201]  178.97,9.19 0 top
R25215  10K  [0201]  178.97,9.8 0 top
R25216  10K  [0201]  178.97,10.41 0 top
R25217  10K  [0201]  178.97,11.02 0 top
R25218  10K  [0201]  178.97,11.63 0 top
R25219  10K  [0201]  178.97,12.24 0 top
R25220  10K  [0201]  178.97,12.85 0 top
R25221  10K  [0201]  178.97,13.46 0 top
R25222  10K  [0201]  178.97,14.07 0 top
R25223  10K  [0201]  178.97,14.68 0 top
R25224  10K  [0201]  178.97,15.29 0 top
R25225  10K  [0201]  178.97,15.9 0 top
R25226  10K  [0201]  178.97,16.51 0 top
R25227  10K  [0201]  178.97,17.12 0 top
R25228  10K  [0201]  178.97,17.73 0 top
R25229  10K  [0201]  178.97,18.34 0 top
R25230  10K  [0201]  178.97,18.95 0 top
R25231  10K  [0201]  178.97,19.56 0 top
R25232  10K  [0201]  178.97,20.17 0 top
R25233  10K  [0201]  178.97,20.78 0 top
R25234  10K  [0201]  178.97,21.39 0 top
R25235  10K  [0201]  178.97,22 0 top
R25236  10K  [0201]  178.97,22.61 0 top
R25237  10K  [0201]  178.97,23.22 0 top
R25238  10K  [0201]  178.97,23.83 0 top
R25239  10K  [0201]  178.97,24.43 0 top
R25240  10K  [0201]  178.97,25.04 0 top
R25241  10K  [0201]  178.97,25.65 0 top
R25242  10K  [0201]  178.97,26.26 0 top
R25243  10K  [0201]  178.97,26.87 0 top
R25244  10K  [0201]  178.97,27.48 0 top
R25245  10K  [0201]  178.97,28.09 0 top
R25246  10K  [0201]  178.97,28.7 0 top
R25247  10K  [0201]  178.97,29.31 0 top
R25248  10K  [0201]  178.97,29.92 0 top
R25249  10K  [0201]  178.97,30.53 0 top
R25250  10K  [0201]  178.97,31.14 0 top
R25251  10K  [0201]  178.97,31.75 0 top
R25252  10K  [0201]  178.97,32.36 0 top
R25253  10K  [0201]  178.97,32.97 0 top
R25254  10K  [0201]  178.97,33.58 0 top
R25255  10K  [0201]  178.97,34.19 0 top
R25256  10K  [0201]  178.97,34.8 0 top
R25257  10K  [0201]  178.97,35.41 0 top
R25258  10K  [0201]  178.97,36.02 0 top
R25259  10K  [0201]  178.97,36.63 0 top
R25260  10K  [0201]  178.97,37.24 0 top
R25261  10K  [0201]  178.97,37.85 0 top
R25262  10K  [0201]  178.97,38.46 0 top
R25263  10K  [0201]  178.97,39.07 0 top
R25264  10K  [0201]  178.97,39.67 0 top
R25265  10K  [0201]  178.97,40.28 0 top
R25266  10K  [0201]  178.97,40.89 0 top
R25267  10K  [0201]  178.97,41.5 0 top
R25268  10K  [0201]  178.97,42.11 0 top
R25269  10K  [0201]  178.97,42.72 0 top
R25270  10K  [0201]  178.97,43.33 0 top
R25271  10K  [0201]  178.97,43.94 0 top
R25272  10K  [0201]  178.97,44.55 0 top
R25273  10K  [0201]  178.97,45.16 0 top
R25274  10K  [0201]  178.97,45.77 0 top
R25275  10K  [0201]  178.97,46.38 0 top
R25276  10K  [0201]  178.97,46.99 0 top
R25277  10K  [0201]  178.97,47.6 0 top
R25278  10K  [0201]  178.97,48.21 0 top
R25279  10K  [0201]  178.97,48.82 0 top
R25280  10K  [0201]  178.97,49.43 0 top
R25281  10K  [0201]  178.97,50.04 0 top
R25282  10K  [0201]  178.97,50.65 0 top
R25283  10K  [0201]  178.97,51.26 0 top
R25284  10K  [0201]  178.97,51.87 0 top
R25285  10K  [0201]  178.97,52.48 0 top
R25286  10K  [0201]  178.97,53.09 0 top
R25287  10K  [0201]  178.97,53.7 0 top
R25288  10K  [0201]  178.97,54.31 0 top
R25289  10K  [0201]  178.97,54.91 0 top
R25290  10K  [0201]  178.97,55.52 0 top
R25291  10K  [0201]  178.97,56.13 0 top
R25292  10K  [0201]  178.97,56.74 0 top
R25293  10K  [0201]  178.97,57.35 0 top
R25294  10K  [0201]  178.97,57.96 0 top
R25295  10K  [0201]  178.97,58.57 0 top
R25296  10K  [0201]  178.97,59.18 0 top
R25297  10K  [0201]  178.97,59.79 0 top
R25298  10K  [0201]  178.97,60.4 0 top
R25299  10K  [0201]  178.97,61.01 0 top
R25300  10K  [0201]  178.97,61.62 0 top
R25301  10K  [0201]  178.97,62.23 0 top
R25302  10K  [0201]  178.97,62.84 0 top
R25303  10K  [0201]  178.97,63.45 0 top
R25304  10K  [0201]  178.97,64.06 0 top
R25305  10K  [0201]  178.97,64.67 0 top
R25306  10K  [0201]  178.97,65.28 0 top
R25307  10K  [0201]  178.97,65.89 0 top
R25308  10K  [0201]  178.97,66.5 0 top
R25309  10K  [0201]  178.97,67.11 0 top
R25310  10K  [0201]  178.97,67.72 0 top
R25311  10K  [0201]  178.97,68.33 0 top
R25312  10K  [0201]  178.97,68.94 0 top
R25313  10K  [0201]  178.97,69.55 0 top
R25314  10K  [0201]  178.97,70.15 0 top
R25315  10K  [0201]  178.97,70.76 0 top
R25316  10K  [0201]  178.97,71.37 0 top
R25317  10K  [0201]  178.97,71.98 0 top
R25318  10K  [0201]  178.97,72.59 0 top
R25319  10K  [0201]  178.97,73.2 0 top
R25320  10K  [0201]  178.97,73.81 0 top
R25321  10K  [0201]  178.97,74.42 0 top
R25322  10K  [0201]  178.97,75.03 0 top
R25323  10K  [0201]  178.97,75.64 0 top
R25324  10K  [0201]  178.97,76.25 0 top
R25325  10K  [0201]  178.97,76.86 0 top
R25326  10K  [0201]  178.97,77.47 0 top
R25327  10K  [0201]  178.97,78.08 0 top
R25328  10K  [0201]  178.97,78.69 0 top
R25329  10K  [0201]  178.97,79.3 0 top
R25330  10K  [0201]  178.97,79.91 0 top
R25331  10K  [0201]  178.97,80.52 0 top
R25332  10K  [0201]  178.97,81.13 0 top
R25333  10K  [0201]  178.97,81.74 0 top
R25334  10K  [0201]  178.97,82.35 0 top
R25335  10K  [0201]  178.97,82.96 0 top
R25336  10K  [0201]  178.97,83.57 0 top
R25337  10K  [0201]  178.97,84.18 0 top
R25338  10K  [0201]  178.97,84.79 0 top
R25339  10K  [0201]  178.97,85.39 0 top
R25340  10K  [0201]  178.97,86 0 top
R25341  10K  [0201]  178.97,86.61 0 top
R25342  10K  [0201]  178.97,87.22 0 top
R25343  10K  [0201]  178.97,87.83 0 top
R25344  10K  [0201]  178.97,88.44 0 top
R25345  10K  [0201]  178.97,89.05 0 top
R25346  10K  [0201]  178.97,89.66 0 top
R25347  10K  [0201]  178.97,90.27 0 top
R25348  10K  [0201]  178.97,90.88 0 top
R25349  10K  [0201]  178.97,91.49 0 top
R25350  10K  [0201]  178.97,92.1 0 top
R25351  10K  [0201]  178.97,92.71 0 top
R25352  10K  [0201]  178.97,93.32 0 top
R25353  10K  [0201]  178.97,93.93 0 top
R25354  10K  [0201]  178.97,94.54 0 top
R25355  10K  [0201]  178.97,95.15 0 top
R25356  10K  [0201]  178.97,95.76 0 top
R25357  10K  [0201]  178.97,96.37 0 top
R25358  10K  [0201]  178.97,96.98 0 top
R25359  10K  [0201]  178.97,97.59 0 top
R25360  10K  [0201]  178.97,98.2 0 top
R25361  10K  [0201]  178.97,98.81 0 top
R25362  10K  [0201]  178.97,99.42 0 top
R25363  10K  [0201]  178.97,100.03 0 top
R25364  10K  [0201]  178.97,100.63 0 top
R25365  10K  [0201]  178.97,101.24 0 top
R25366  10K  [0201]  178.97,101.85 0 top
R25367  10K  [0201]  178.97,102.46 0 top
R25368  10K  [0201]  178.97,103.07 0 top
R25369  10K  [0201]  178.97,103.68 0 top
R25370  10K  [0201]  178.97,104.29 0 top
R25371  10K  [0201]  178.97,104.9 0 top
R25372  10K  [0201]  178.97,105.51 0 top
R25373  10K  [0201]  178.97,106.12 0 top
R25374  10K  [0201]  178.97,106.73 0 top
R25375  10K  [0201]  178.97,107.34 0 top
R25376  10K  [0201]  178.97,107.95 0 top
R25377  10K  [0201]  178.97,108.56 0 top
R25378  10K  [0201]  178.97,109.17 0 top
R25379  10K  [0201]  178.97,109.78 0 top
R25380  10K  [0201]  178.97,110.39 0 top
R25381  10K  [0201]  178.97,111 0 top
R25382  10K  [0201]  178.97,111.61 0 top
R25383  10K  [0201]  178.97,112.22 0 top
R25384  10K  [0201]  178.97,112.83 0 top
R25385  10K  [0201]  178.97,113.44 0 top
R25386  10K  [0201]  178.97,114.05 0 top
R25387  10K  [0201]  178.97,114.66 0 top
R25388  10K  [0201]  178.97,115.27 0 top
R25389  10K  [0201]  178.97,115.87 0 top
R25390  10K  [0201]  178.97,116.48 0 top
R25391  10K  [0201]  178.97,117.09 0 top
R25392  10K  [0201]  178.97,117.7 0 top
R25393  10K  [0201]  178.97,118.31 0 top
R25394  10K  [0201]  178.97,118.92 0 top
R25395  10K  [0201]  178.97,119.53 0 top
R25396  10K  [0201]  178.97,120.14 0 top
R25397  10K  [0201]  178.97,120.75 0 top
R25398  10K  [0201]  178.97,121.36 0 top
R25399  10K  [0201]  178.97,121.97 0 top
R25400  10K  [0201]  178.97,122.58 0 top
R25401  10K  [0201]  180.19,1.27 0 top
R25402  10K  [0201]  180.19,1.88 0 top
R25403  10K  [0201]  180.19,2.49 0 top
R25404  10K  [0201]  180.19,3.1 0 top
R25405  10K  [0201]  180.19,3.71 0 top
R25406  10K  [0201]  180.19,4.32 0 top
R25407  10K  [0201]  180.19,4.93 0 top
R25408  10K  [0201]  180.19,5.54 0 top
R25409  10K  [0201]  180.19,6.15 0 top
R25410  10K  [0201]  180.19,6.76 0 top
R25411  10K  [0201]  180.19,7.37 0 top
R25412  10K  [0201]  180.19,7.98 0 top
R25413  10K  [0201]  180.19,8.59 0 top
R25414  10K  [0201]  180.19,9.19 0 top
R25415  10K  [0201]  180.19,9.8 0 top
R25416  10K  [0201]  180.19,10.41 0 top
R25417  10K  [0201]  180.19,11.02 0 top
R25418  10K  [0201]  180.19,11.63 0 top
R25419  10K  [0201]  180.19,12.24 0 top
R25420  10K  [0201]  180.19,12.85 0 top
R25421  10K  [0201]  180.19,13.46 0 top
R25422  10K  [0201]  180.19,14.07 0 top
R25423  10K  [0201]  180.19,14.68 0 top
R25424  10K  [0201]  180.19,15.29 0 top
R25425  10K  [0201]  180.19,15.9 0 top
R25426  10K  [0201]  180.19,16.51 0 top
R25427  10K  [0201]  180.19,17.12 0 top
R25428  10K  [0201]  180.19,17.73 0 top
R25429  10K  [0201]  180.19,18.34 0 top
R25430  10K  [0201]  180.19,18.95 0 top
R25431  10K  [0201]  180.19,19.56 0 top
R25432  10K  [0201]  180.19,20.17 0 top
R25433  10K  [0201]  180.19,20.78 0 top
R25434  10K  [0201]  180.19,21.39 0 top
R25435  10K  [0201]  180.19,22 0 top
R25436  10K  [0201]  180.19,22.61 0 top
R25437  10K  [0201]  180.19,23.22 0 top
R25438  10K  [0201]  180.19,23.83 0 top
R25439  10K  [0201]  180.19,24.43 0 top
R25440  10K  [0201]  180.19,25.04 0 top
R25441  10K  [0201]  180.19,25.65 0 top
R25442  10K  [0201]  180.19,26.26 0 top
R25443  10K  [0201]  180.19,26.87 0 top
R25444  10K  [0201]  180.19,27.48 0 top
R25445  10K  [0201]  180.19,28.09 0 top
R25446  10K  [0201]  180.19,28.7 0 top
R25447  10K  [0201]  180.19,29.31 0 top
R25448  10K  [0201]  180.19,29.92 0 top
R25449  10K  [0201]  180.19,30.53 0 top
R25450  10K  [0201]  180.19,31.14 0 top
R25451  10K  [0201]  180.19,31.75 0 top
R25452  10K  [0201]  180.19,32.36 0 top
R25453  10K  [0201]  180.19,32.97 0 top
R25454  10K  [0201]  180.19,33.58 0 top
R25455  10K  [0201]  180.19,34.19 0 top
R25456  10K  [0201]  180.19,34.8 0 top
R25457  10K  [0201]  180.19,35.41 0 top
R25458  10K  [0201]  180.19,36.02 0 top
R25459  10K  [0201]  180.19,36.63 0 top
R25460  10K  [0201]  180.19,37.24 0 top
R25461  10K  [0201]  180.19,37.85 0 top
R25462  10K  [0201]  180.19,38.46 0 top
R25463  10K  [0201]  180.19,39.07 0 top
R25464  10K  [0201]  180.19,39.67 0 top
R25465  10K  [0201]  180.19,40.28 0 top
R25466  10K  [0201]  180.19,40.89 0 top
R25467  10K  [0201]  180.19,41.5 0 top
R25468  10K  [0201]  180.19,42.11 0 top
R25469  10K  [0201]  180.19,42.72 0 top
R25470  10K  [0201]  180.19,43.33 0 top
R25471  10K  [0201]  180.19,43.94 0 top
R25472  10K  [0201]  180.19,44.55 0 top
R25473  10K  [0201]  180.19,45.16 0 top
R25474  10K  [0201]  180.19,45.77 0 top
R25475  10K  [0201]  180.19,46.38 0 top